# EAGLE schematic Resistor_Resistor (EAGLE 8.3.0), part 3 of 43 (continued)
## Parts (continued)
R3670  10K  RESISTOR_0201  [0201]
R3671  10K  RESISTOR_0201  [0201]
R3672  10K  RESISTOR_0201  [0201]
R3673  10K  RESISTOR_0201  [0201]
R3674  10K  RESISTOR_0201  [0201]
R3675  10K  RESISTOR_0201  [0201]
R3676  10K  RESISTOR_0201  [0201]
R3677  10K  RESISTOR_0201  [0201]
R3678  10K  RESISTOR_0201  [0201]
R3679  10K  RESISTOR_0201  [0201]
R3680  10K  RESISTOR_0201  [0201]
R3681  10K  RESISTOR_0201  [0201]
R3682  10K  RESISTOR_0201  [0201]
R3683  10K  RESISTOR_0201  [0201]
R3684  10K  RESISTOR_0201  [0201]
R3685  10K  RESISTOR_0201  [0201]
R3686  10K  RESISTOR_0201  [0201]
R3687  10K  RESISTOR_0201  [0201]
R3688  10K  RESISTOR_0201  [0201]
R3689  10K  RESISTOR_0201  [0201]
R3690  10K  RESISTOR_0201  [0201]
R3691  10K  RESISTOR_0201  [0201]
R3692  10K  RESISTOR_0201  [0201]
R3693  10K  RESISTOR_0201  [0201]
R3694  10K  RESISTOR_0201  [0201]
R3695  10K  RESISTOR_0201  [0201]
R3696  10K  RESISTOR_0201  [0201]
R3697  10K  RESISTOR_0201  [0201]
R3698  10K  RESISTOR_0201  [0201]
R3699  10K  RESISTOR_0201  [0201]
R3700  10K  RESISTOR_0201  [0201]
R3701  10K  RESISTOR_0201  [0201]
R3702  10K  RESISTOR_0201  [0201]
R3703  10K  RESISTOR_0201  [0201]
R3704  10K  RESISTOR_0201  [0201]
R3705  10K  RESISTOR_0201  [0201]
R3706  10K  RESISTOR_0201  [0201]
R3707  10K  RESISTOR_0201  [0201]
R3708  10K  RESISTOR_0201  [0201]
R3709  10K  RESISTOR_0201  [0201]
R3710  10K  RESISTOR_0201  [0201]
R3711  10K  RESISTOR_0201  [0201]
R3712  10K  RESISTOR_0201  [0201]
R3713  10K  RESISTOR_0201  [0201]
R3714  10K  RESISTOR_0201  [0201]
R3715  10K  RESISTOR_0201  [0201]
R3716  10K  RESISTOR_0201  [0201]
R3717  10K  RESISTOR_0201  [0201]
R3718  10K  RESISTOR_0201  [0201]
R3719  10K  RESISTOR_0201  [0201]
R3720  10K  RESISTOR_0201  [0201]
R3721  10K  RESISTOR_0201  [0201]
R3722  10K  RESISTOR_0201  [0201]
R3723  10K  RESISTOR_0201  [0201]
R3724  10K  RESISTOR_0201  [0201]
R3725  10K  RESISTOR_0201  [0201]
R3726  10K  RESISTOR_0201  [0201]
R3727  10K  RESISTOR_0201  [0201]
R3728  10K  RESISTOR_0201  [0201]
R3729  10K  RESISTOR_0201  [0201]
R3730  10K  RESISTOR_0201  [0201]
R3731  10K  RESISTOR_0201  [0201]
R3732  10K  RESISTOR_0201  [0201]
R3733  10K  RESISTOR_0201  [0201]
R3734  10K  RESISTOR_0201  [0201]
R3735  10K  RESISTOR_0201  [0201]
R3736  10K  RESISTOR_0201  [0201]
R3737  10K  RESISTOR_0201  [0201]
R3738  10K  RESISTOR_0201  [0201]
R3739  10K  RESISTOR_0201  [0201]
R3740  10K  RESISTOR_0201  [0201]
R3741  10K  RESISTOR_0201  [0201]
R3742  10K  RESISTOR_0201  [0201]
R3743  10K  RESISTOR_0201  [0201]
R3744  10K  RESISTOR_0201  [0201]
R3745  10K  RESISTOR_0201  [0201]
R3746  10K  RESISTOR_0201  [0201]
R3747  10K  RESISTOR_0201  [0201]
R3748  10K  RESISTOR_0201  [0201]
R3749  10K  RESISTOR_0201  [0201]
R3750  10K  RESISTOR_0201  [0201]
R3751  10K  RESISTOR_0201  [0201]
R3752  10K  RESISTOR_0201  [0201]
R3753  10K  RESISTOR_0201  [0201]
R3754  10K  RESISTOR_0201  [0201]
R3755  10K  RESISTOR_0201  [0201]
R3756  10K  RESISTOR_0201  [0201]
R3757  10K  RESISTOR_0201  [0201]
R3758  10K  RESISTOR_0201  [0201]
R3759  10K  RESISTOR_0201  [0201]
R3760  10K  RESISTOR_0201  [0201]
R3761  10K  RESISTOR_0201  [0201]
R3762  10K  RESISTOR_0201  [0201]
R3763  10K  RESISTOR_0201  [0201]
R3764  10K  RESISTOR_0201  [0201]
R3765  10K  RESISTOR_0201  [0201]
R3766  10K  RESISTOR_0201  [0201]
R3767  10K  RESISTOR_0201  [0201]
R3768  10K  RESISTOR_0201  [0201]
R3769  10K  RESISTOR_0201  [0201]
R3770  10K  RESISTOR_0201  [0201]
R3771  10K  RESISTOR_0201  [0201]
R3772  10K  RESISTOR_0201  [0201]
R3773  10K  RESISTOR_0201  [0201]
R3774  10K  RESISTOR_0201  [0201]
R3775  10K  RESISTOR_0201  [0201]
R3776  10K  RESISTOR_0201  [0201]
R3777  10K  RESISTOR_0201  [0201]
R3778  10K  RESISTOR_0201  [0201]
R3779  10K  RESISTOR_0201  [0201]
R3780  10K  RESISTOR_0201  [0201]
R3781  10K  RESISTOR_0201  [0201]
R3782  10K  RESISTOR_0201  [0201]
R3783  10K  RESISTOR_0201  [0201]
R3784  10K  RESISTOR_0201  [0201]
R3785  10K  RESISTOR_0201  [0201]
R3786  10K  RESISTOR_0201  [0201]
R3787  10K  RESISTOR_0201  [0201]
R3788  10K  RESISTOR_0201  [0201]
R3789  10K  RESISTOR_0201  [0201]
R3790  10K  RESISTOR_0201  [0201]
R3791  10K  RESISTOR_0201  [0201]
R3792  10K  RESISTOR_0201  [0201]
R3793  10K  RESISTOR_0201  [0201]
R3794  10K  RESISTOR_0201  [0201]
R3795  10K  RESISTOR_0201  [0201]
R3796  10K  RESISTOR_0201  [0201]
R3797  10K  RESISTOR_0201  [0201]
R3798  10K  RESISTOR_0201  [0201]
R3799  10K  RESISTOR_0201  [0201]
R3800  10K  RESISTOR_0201  [0201]
R3801  10K  RESISTOR_0201  [0201]
R3802  10K  RESISTOR_0201  [0201]
R3803  10K  RESISTOR_0201  [0201]
R3804  10K  RESISTOR_0201  [0201]
R3805  10K  RESISTOR_0201  [0201]
R3806  10K  RESISTOR_0201  [0201]
R3807  10K  RESISTOR_0201  [0201]
R3808  10K  RESISTOR_0201  [0201]
R3809  10K  RESISTOR_0201  [0201]
R3810  10K  RESISTOR_0201  [0201]
R3811  10K  RESISTOR_0201  [0201]
R3812  10K  RESISTOR_0201  [0201]
R3813  10K  RESISTOR_0201  [0201]
R3814  10K  RESISTOR_0201  [0201]
R3815  10K  RESISTOR_0201  [0201]
R3816  10K  RESISTOR_0201  [0201]
R3817  10K  RESISTOR_0201  [0201]
R3818  10K  RESISTOR_0201  [0201]
R3819  10K  RESISTOR_0201  [0201]
R3820  10K  RESISTOR_0201  [0201]
R3821  10K  RESISTOR_0201  [0201]
R3822  10K  RESISTOR_0201  [0201]
R3823  10K  RESISTOR_0201  [0201]
R3824  10K  RESISTOR_0201  [0201]
R3825  10K  RESISTOR_0201  [0201]
R3826  10K  RESISTOR_0201  [0201]
R3827  10K  RESISTOR_0201  [0201]
R3828  10K  RESISTOR_0201  [0201]
R3829  10K  RESISTOR_0201  [0201]
R3830  10K  RESISTOR_0201  [0201]
R3831  10K  RESISTOR_0201  [0201]
R3832  10K  RESISTOR_0201  [0201]
R3833  10K  RESISTOR_0201  [0201]
R3834  10K  RESISTOR_0201  [0201]
R3835  10K  RESISTOR_0201  [0201]
R3836  10K  RESISTOR_0201  [0201]
R3837  10K  RESISTOR_0201  [0201]
R3838  10K  RESISTOR_0201  [0201]
R3839  10K  RESISTOR_0201  [0201]
R3840  10K  RESISTOR_0201  [0201]
R3841  10K  RESISTOR_0201  [0201]
R3842  10K  RESISTOR_0201  [0201]
R3843  10K  RESISTOR_0201  [0201]
R3844  10K  RESISTOR_0201  [0201]
R3845  10K  RESISTOR_0201  [0201]
R3846  10K  RESISTOR_0201  [0201]
R3847  10K  RESISTOR_0201  [0201]
R3848  10K  RESISTOR_0201  [0201]
R3849  10K  RESISTOR_0201  [0201]
R3850  10K  RESISTOR_0201  [0201]
R3851  10K  RESISTOR_0201  [0201]
R3852  10K  RESISTOR_0201  [0201]
R3853  10K  RESISTOR_0201  [0201]
R3854  10K  RESISTOR_0201  [0201]
R3855  10K  RESISTOR_0201  [0201]
R3856  10K  RESISTOR_0201  [0201]
R3857  10K  RESISTOR_0201  [0201]
R3858  10K  RESISTOR_0201  [0201]
R3859  10K  RESISTOR_0201  [0201]
R3860  10K  RESISTOR_0201  [0201]
R3861  10K  RESISTOR_0201  [0201]
R3862  10K  RESISTOR_0201  [0201]
R3863  10K  RESISTOR_0201  [0201]
R3864  10K  RESISTOR_0201  [0201]
R3865  10K  RESISTOR_0201  [0201]
R3866  10K  RESISTOR_0201  [0201]
R3867  10K  RESISTOR_0201  [0201]
R3868  10K  RESISTOR_0201  [0201]
R3869  10K  RESISTOR_0201  [0201]
R3870  10K  RESISTOR_0201  [0201]
R3871  10K  RESISTOR_0201  [0201]
R3872  10K  RESISTOR_0201  [0201]
R3873  10K  RESISTOR_0201  [0201]
R3874  10K  RESISTOR_0201  [0201]
R3875  10K  RESISTOR_0201  [0201]
R3876  10K  RESISTOR_0201  [0201]
R3877  10K  RESISTOR_0201  [0201]
R3878  10K  RESISTOR_0201  [0201]
R3879  10K  RESISTOR_0201  [0201]
R3880  10K  RESISTOR_0201  [0201]
R3881  10K  RESISTOR_0201  [0201]
R3882  10K  RESISTOR_0201  [0201]
R3883  10K  RESISTOR_0201  [0201]
R3884  10K  RESISTOR_0201  [0201]
R3885  10K  RESISTOR_0201  [0201]
R3886  10K  RESISTOR_0201  [0201]
R3887  10K  RESISTOR_0201  [0201]
R3888  10K  RESISTOR_0201  [0201]
R3889  10K  RESISTOR_0201  [0201]
R3890  10K  RESISTOR_0201  [0201]
R3891  10K  RESISTOR_0201  [0201]
R3892  10K  RESISTOR_0201  [0201]
R3893  10K  RESISTOR_0201  [0201]
R3894  10K  RESISTOR_0201  [0201]
R3895  10K  RESISTOR_0201  [0201]
R3896  10K  RESISTOR_0201  [0201]
R3897  10K  RESISTOR_0201  [0201]
R3898  10K  RESISTOR_0201  [0201]
R3899  10K  RESISTOR_0201  [0201]
R3900  10K  RESISTOR_0201  [0201]
R3901  10K  RESISTOR_0201  [0201]
R3902  10K  RESISTOR_0201  [0201]
R3903  10K  RESISTOR_0201  [0201]
R3904  10K  RESISTOR_0201  [0201]
R3905  10K  RESISTOR_0201  [0201]
R3906  10K  RESISTOR_0201  [0201]
R3907  10K  RESISTOR_0201  [0201]
R3908  10K  RESISTOR_0201  [0201]
R3909  10K  RESISTOR_0201  [0201]
R3910  10K  RESISTOR_0201  [0201]
R3911  10K  RESISTOR_0201  [0201]
R3912  10K  RESISTOR_0201  [0201]
R3913  10K  RESISTOR_0201  [0201]
R3914  10K  RESISTOR_0201  [0201]
R3915  10K  RESISTOR_0201  [0201]
R3916  10K  RESISTOR_0201  [0201]
R3917  10K  RESISTOR_0201  [0201]
R3918  10K  RESISTOR_0201  [0201]
R3919  10K  RESISTOR_0201  [0201]
R3920  10K  RESISTOR_0201  [0201]
R3921  10K  RESISTOR_0201  [0201]
R3922  10K  RESISTOR_0201  [0201]
R3923  10K  RESISTOR_0201  [0201]
R3924  10K  RESISTOR_0201  [0201]
R3925  10K  RESISTOR_0201  [0201]
R3926  10K  RESISTOR_0201  [0201]
R3927  10K  RESISTOR_0201  [0201]
R3928  10K  RESISTOR_0201  [0201]
R3929  10K  RESISTOR_0201  [0201]
R3930  10K  RESISTOR_0201  [0201]
R3931  10K  RESISTOR_0201  [0201]
R3932  10K  RESISTOR_0201  [0201]
R3933  10K  RESISTOR_0201  [0201]
R3934  10K  RESISTOR_0201  [0201]
R3935  10K  RESISTOR_0201  [0201]
R3936  10K  RESISTOR_0201  [0201]
R3937  10K  RESISTOR_0201  [0201]
R3938  10K  RESISTOR_0201  [0201]
R3939  10K  RESISTOR_0201  [0201]
R3940  10K  RESISTOR_0201  [0201]
R3941  10K  RESISTOR_0201  [0201]
R3942  10K  RESISTOR_0201  [0201]
R3943  10K  RESISTOR_0201  [0201]
R3944  10K  RESISTOR_0201  [0201]
R3945  10K  RESISTOR_0201  [0201]
R3946  10K  RESISTOR_0201  [0201]
R3947  10K  RESISTOR_0201  [0201]
R3948  10K  RESISTOR_0201  [0201]
R3949  10K  RESISTOR_0201  [0201]
R3950  10K  RESISTOR_0201  [0201]
R3951  10K  RESISTOR_0201  [0201]
R3952  10K  RESISTOR_0201  [0201]
R3953  10K  RESISTOR_0201  [0201]
R3954  10K  RESISTOR_0201  [0201]
R3955  10K  RESISTOR_0201  [0201]
R3956  10K  RESISTOR_0201  [0201]
R3957  10K  RESISTOR_0201  [0201]
R3958  10K  RESISTOR_0201  [0201]
R3959  10K  RESISTOR_0201  [0201]
R3960  10K  RESISTOR_0201  [0201]
R3961  10K  RESISTOR_0201  [0201]
R3962  10K  RESISTOR_0201  [0201]
R3963  10K  RESISTOR_0201  [0201]
R3964  10K  RESISTOR_0201  [0201]
R3965  10K  RESISTOR_0201  [0201]
R3966  10K  RESISTOR_0201  [0201]
R3967  10K  RESISTOR_0201  [0201]
R3968  10K  RESISTOR_0201  [0201]
R3969  10K  RESISTOR_0201  [0201]
R3970  10K  RESISTOR_0201  [0201]
R3971  10K  RESISTOR_0201  [0201]
R3972  10K  RESISTOR_0201  [0201]
R3973  10K  RESISTOR_0201  [0201]
R3974  10K  RESISTOR_0201  [0201]
R3975  10K  RESISTOR_0201  [0201]
R3976  10K  RESISTOR_0201  [0201]
R3977  10K  RESISTOR_0201  [0201]
R3978  10K  RESISTOR_0201  [0201]
R3979  10K  RESISTOR_0201  [0201]
R3980  10K  RESISTOR_0201  [0201]
R3981  10K  RESISTOR_0201  [0201]
R3982  10K  RESISTOR_0201  [0201]
R3983  10K  RESISTOR_0201  [0201]
R3984  10K  RESISTOR_0201  [0201]
R3985  10K  RESISTOR_0201  [0201]
R3986  10K  RESISTOR_0201  [0201]
R3987  10K  RESISTOR_0201  [0201]
R3988  10K  RESISTOR_0201  [0201]
R3989  10K  RESISTOR_0201  [0201]
R3990  10K  RESISTOR_0201  [0201]
R3991  10K  RESISTOR_0201  [0201]
R3992  10K  RESISTOR_0201  [0201]
R3993  10K  RESISTOR_0201  [0201]
R3994  10K  RESISTOR_0201  [0201]
R3995  10K  RESISTOR_0201  [0201]
R3996  10K  RESISTOR_0201  [0201]
R3997  10K  RESISTOR_0201  [0201]
R3998  10K  RESISTOR_0201  [0201]
R3999  10K  RESISTOR_0201  [0201]
R4000  10K  RESISTOR_0201  [0201]
R4001  10K  RESISTOR_0201  [0201]
R4002  10K  RESISTOR_0201  [0201]
R4003  10K  RESISTOR_0201  [0201]
R4004  10K  RESISTOR_0201  [0201]
R4005  10K  RESISTOR_0201  [0201]
R4006  10K  RESISTOR_0201  [0201]
R4007  10K  RESISTOR_0201  [0201]
R4008  10K  RESISTOR_0201  [0201]
R4009  10K  RESISTOR_0201  [0201]
R4010  10K  RESISTOR_0201  [0201]
R4011  10K  RESISTOR_0201  [0201]
R4012  10K  RESISTOR_0201  [0201]
R4013  10K  RESISTOR_0201  [0201]
R4014  10K  RESISTOR_0201  [0201]
R4015  10K  RESISTOR_0201  [0201]
R4016  10K  RESISTOR_0201  [0201]
R4017  10K  RESISTOR_0201  [0201]
R4018  10K  RESISTOR_0201  [0201]
R4019  10K  RESISTOR_0201  [0201]
R4020  10K  RESISTOR_0201  [0201]
R4021  10K  RESISTOR_0201  [0201]
R4022  10K  RESISTOR_0201  [0201]
R4023  10K  RESISTOR_0201  [0201]
R4024  10K  RESISTOR_0201  [0201]
R4025  10K  RESISTOR_0201  [0201]
R4026  10K  RESISTOR_0201  [0201]
R4027  10K  RESISTOR_0201  [0201]
R4028  10K  RESISTOR_0201  [0201]
R4029  10K  RESISTOR_0201  [0201]
R4030  10K  RESISTOR_0201  [0201]
R4031  10K  RESISTOR_0201  [0201]
R4032  10K  RESISTOR_0201  [0201]
R4033  10K  RESISTOR_0201  [0201]
R4034  10K  RESISTOR_0201  [0201]
R4035  10K  RESISTOR_0201  [0201]
R4036  10K  RESISTOR_0201  [0201]
R4037  10K  RESISTOR_0201  [0201]
R4038  10K  RESISTOR_0201  [0201]
R4039  10K  RESISTOR_0201  [0201]
R4040  10K  RESISTOR_0201  [0201]
R4041  10K  RESISTOR_0201  [0201]
R4042  10K  RESISTOR_0201  [0201]
R4043  10K  RESISTOR_0201  [0201]
R4044  10K  RESISTOR_0201  [0201]
R4045  10K  RESISTOR_0201  [0201]
R4046  10K  RESISTOR_0201  [0201]
R4047  10K  RESISTOR_0201  [0201]
R4048  10K  RESISTOR_0201  [0201]
R4049  10K  RESISTOR_0201  [0201]
R4050  10K  RESISTOR_0201  [0201]
R4051  10K  RESISTOR_0201  [0201]
R4052  10K  RESISTOR_0201  [0201]
R4053  10K  RESISTOR_0201  [0201]
R4054  10K  RESISTOR_0201  [0201]
R4055  10K  RESISTOR_0201  [0201]
R4056  10K  RESISTOR_0201  [0201]
R4057  10K  RESISTOR_0201  [0201]
R4058  10K  RESISTOR_0201  [0201]
R4059  10K  RESISTOR_0201  [0201]
R4060  10K  RESISTOR_0201  [0201]
R4061  10K  RESISTOR_0201  [0201]
R4062  10K  RESISTOR_0201  [0201]
R4063  10K  RESISTOR_0201  [0201]
R4064  10K  RESISTOR_0201  [0201]
R4065  10K  RESISTOR_0201  [0201]
R4066  10K  RESISTOR_0201  [0201]
R4067  10K  RESISTOR_0201  [0201]
R4068  10K  RESISTOR_0201  [0201]
R4069  10K  RESISTOR_0201  [0201]
R4070  10K  RESISTOR_0201  [0201]
R4071  10K  RESISTOR_0201  [0201]
R4072  10K  RESISTOR_0201  [0201]
R4073  10K  RESISTOR_0201  [0201]
R4074  10K  RESISTOR_0201  [0201]
R4075  10K  RESISTOR_0201  [0201]
R4076  10K  RESISTOR_0201  [0201]
R4077  10K  RESISTOR_0201  [0201]
R4078  10K  RESISTOR_0201  [0201]
R4079  10K  RESISTOR_0201  [0201]
R4080  10K  RESISTOR_0201  [0201]
R4081  10K  RESISTOR_0201  [0201]
R4082  10K  RESISTOR_0201  [0201]
R4083  10K  RESISTOR_0201  [0201]
R4084  10K  RESISTOR_0201  [0201]
R4085  10K  RESISTOR_0201  [0201]
R4086  10K  RESISTOR_0201  [0201]
R4087  10K  RESISTOR_0201  [0201]
R4088  10K  RESISTOR_0201  [0201]
R4089  10K  RESISTOR_0201  [0201]
R4090  10K  RESISTOR_0201  [0201]
R4091  10K  RESISTOR_0201  [0201]
R4092  10K  RESISTOR_0201  [0201]
R4093  10K  RESISTOR_0201  [0201]
R4094  10K  RESISTOR_0201  [0201]
R4095  10K  RESISTOR_0201  [0201]
R4096  10K  RESISTOR_0201  [0201]
R4097  10K  RESISTOR_0201  [0201]
R4098  10K  RESISTOR_0201  [0201]
R4099  10K  RESISTOR_0201  [0201]
R4100  10K  RESISTOR_0201  [0201]
R4101  10K  RESISTOR_0201  [0201]
R4102  10K  RESISTOR_0201  [0201]
R4103  10K  RESISTOR_0201  [0201]
R4104  10K  RESISTOR_0201  [0201]
R4105  10K  RESISTOR_0201  [0201]
R4106  10K  RESISTOR_0201  [0201]
R4107  10K  RESISTOR_0201  [0201]
R4108  10K  RESISTOR_0201  [0201]
R4109  10K  RESISTOR_0201  [0201]
R4110  10K  RESISTOR_0201  [0201]
R4111  10K  RESISTOR_0201  [0201]
R4112  10K  RESISTOR_0201  [0201]
R4113  10K  RESISTOR_0201  [0201]
R4114  10K  RESISTOR_0201  [0201]
R4115  10K  RESISTOR_0201  [0201]
R4116  10K  RESISTOR_0201  [0201]
R4117  10K  RESISTOR_0201  [0201]
R4118  10K  RESISTOR_0201  [0201]
R4119  10K  RESISTOR_0201  [0201]
R4120  10K  RESISTOR_0201  [0201]
R4121  10K  RESISTOR_0201  [0201]
R4122  10K  RESISTOR_0201  [0201]
R4123  10K  RESISTOR_0201  [0201]
R4124  10K  RESISTOR_0201  [0201]
R4125  10K  RESISTOR_0201  [0201]
R4126  10K  RESISTOR_0201  [0201]
R4127  10K  RESISTOR_0201  [0201]
R4128  10K  RESISTOR_0201  [0201]
R4129  10K  RESISTOR_0201  [0201]
R4130  10K  RESISTOR_0201  [0201]
R4131  10K  RESISTOR_0201  [0201]
R4132  10K  RESISTOR_0201  [0201]
R4133  10K  RESISTOR_0201  [0201]
R4134  10K  RESISTOR_0201  [0201]
R4135  10K  RESISTOR_0201  [0201]
R4136  10K  RESISTOR_0201  [0201]
R4137  10K  RESISTOR_0201  [0201]
R4138  10K  RESISTOR_0201  [0201]
R4139  10K  RESISTOR_0201  [0201]
R4140  10K  RESISTOR_0201  [0201]
R4141  10K  RESISTOR_0201  [0201]
R4142  10K  RESISTOR_0201  [0201]
R4143  10K  RESISTOR_0201  [0201]
R4144  10K  RESISTOR_0201  [0201]
R4145  10K  RESISTOR_0201  [0201]
R4146  10K  RESISTOR_0201  [0201]
R4147  10K  RESISTOR_0201  [0201]
R4148  10K  RESISTOR_0201  [0201]
R4149  10K  RESISTOR_0201  [0201]
R4150  10K  RESISTOR_0201  [0201]
R4151  10K  RESISTOR_0201  [0201]
R4152  10K  RESISTOR_0201  [0201]
R4153  10K  RESISTOR_0201  [0201]
R4154  10K  RESISTOR_0201  [0201]
R4155  10K  RESISTOR_0201  [0201]
R4156  10K  RESISTOR_0201  [0201]
R4157  10K  RESISTOR_0201  [0201]
R4158  10K  RESISTOR_0201  [0201]
R4159  10K  RESISTOR_0201  [0201]
R4160  10K  RESISTOR_0201  [0201]
R4161  10K  RESISTOR_0201  [0201]
R4162  10K  RESISTOR_0201  [0201]
R4163  10K  RESISTOR_0201  [0201]
R4164  10K  RESISTOR_0201  [0201]
R4165  10K  RESISTOR_0201  [0201]
R4166  10K  RESISTOR_0201  [0201]
R4167  10K  RESISTOR_0201  [0201]
R4168  10K  RESISTOR_0201  [0201]
R4169  10K  RESISTOR_0201  [0201]
R4170  10K  RESISTOR_0201  [0201]
R4171  10K  RESISTOR_0201  [0201]
R4172  10K  RESISTOR_0201  [0201]
R4173  10K  RESISTOR_0201  [0201]
R4174  10K  RESISTOR_0201  [0201]
R4175  10K  RESISTOR_0201  [0201]
R4176  10K  RESISTOR_0201  [0201]
R4177  10K  RESISTOR_0201  [0201]
R4178  10K  RESISTOR_0201  [0201]
R4179  10K  RESISTOR_0201  [0201]
R4180  10K  RESISTOR_0201  [0201]
R4181  10K  RESISTOR_0201  [0201]
R4182  10K  RESISTOR_0201  [0201]
R4183  10K  RESISTOR_0201  [0201]
R4184  10K  RESISTOR_0201  [0201]
R4185  10K  RESISTOR_0201  [0201]
R4186  10K  RESISTOR_0201  [0201]
R4187  10K  RESISTOR_0201  [0201]
R4188  10K  RESISTOR_0201  [0201]
R4189  10K  RESISTOR_0201  [0201]
R4190  10K  RESISTOR_0201  [0201]
R4191  10K  RESISTOR_0201  [0201]
R4192  10K  RESISTOR_0201  [0201]
R4193  10K  RESISTOR_0201  [0201]
R4194  10K  RESISTOR_0201  [0201]
R4195  10K  RESISTOR_0201  [0201]
R4196  10K  RESISTOR_0201  [0201]
R4197  10K  RESISTOR_0201  [0201]
R4198  10K  RESISTOR_0201  [0201]
R4199  10K  RESISTOR_0201  [0201]
R4200  10K  RESISTOR_0201  [0201]
R4201  10K  RESISTOR_0201  [0201]
R4202  10K  RESISTOR_0201  [0201]
R4203  10K  RESISTOR_0201  [0201]
R4204  10K  RESISTOR_0201  [0201]
R4205  10K  RESISTOR_0201  [0201]
R4206  10K  RESISTOR_0201  [0201]
R4207  10K  RESISTOR_0201  [0201]
R4208  10K  RESISTOR_0201  [0201]
R4209  10K  RESISTOR_0201  [0201]
R4210  10K  RESISTOR_0201  [0201]
R4211  10K  RESISTOR_0201  [0201]
R4212  10K  RESISTOR_0201  [0201]
R4213  10K  RESISTOR_0201  [0201]
R4214  10K  RESISTOR_0201  [0201]
R4215  10K  RESISTOR_0201  [0201]
R4216  10K  RESISTOR_0201  [0201]
R4217  10K  RESISTOR_0201  [0201]
R4218  10K  RESISTOR_0201  [0201]
R4219  10K  RESISTOR_0201  [0201]
R4220  10K  RESISTOR_0201  [0201]
R4221  10K  RESISTOR_0201  [0201]
R4222  10K  RESISTOR_0201  [0201]
R4223  10K  RESISTOR_0201  [0201]
R4224  10K  RESISTOR_0201  [0201]
R4225  10K  RESISTOR_0201  [0201]
R4226  10K  RESISTOR_0201  [0201]
R4227  10K  RESISTOR_0201  [0201]
R4228  10K  RESISTOR_0201  [0201]
R4229  10K  RESISTOR_0201  [0201]
R4230  10K  RESISTOR_0201  [0201]
R4231  10K  RESISTOR_0201  [0201]
R4232  10K  RESISTOR_0201  [0201]
R4233  10K  RESISTOR_0201  [0201]
R4234  10K  RESISTOR_0201  [0201]
R4235  10K  RESISTOR_0201  [0201]
R4236  10K  RESISTOR_0201  [0201]
R4237  10K  RESISTOR_0201  [0201]
R4238  10K  RESISTOR_0201  [0201]
R4239  10K  RESISTOR_0201  [0201]
R4240  10K  RESISTOR_0201  [0201]
R4241  10K  RESISTOR_0201  [0201]
R4242  10K  RESISTOR_0201  [0201]
R4243  10K  RESISTOR_0201  [0201]
R4244  10K  RESISTOR_0201  [0201]
R4245  10K  RESISTOR_0201  [0201]
R4246  10K  RESISTOR_0201  [0201]
R4247  10K  RESISTOR_0201  [0201]
R4248  10K  RESISTOR_0201  [0201]
R4249  10K  RESISTOR_0201  [0201]
R4250  10K  RESISTOR_0201  [0201]
R4251  10K  RESISTOR_0201  [0201]
R4252  10K  RESISTOR_0201  [0201]
R4253  10K  RESISTOR_0201  [0201]
R4254  10K  RESISTOR_0201  [0201]
R4255  10K  RESISTOR_0201  [0201]
R4256  10K  RESISTOR_0201  [0201]
R4257  10K  RESISTOR_0201  [0201]
R4258  10K  RESISTOR_0201  [0201]
R4259  10K  RESISTOR_0201  [0201]
R4260  10K  RESISTOR_0201  [0201]
R4261  10K  RESISTOR_0201  [0201]
R4262  10K  RESISTOR_0201  [0201]
R4263  10K  RESISTOR_0201  [0201]
R4264  10K  RESISTOR_0201  [0201]
R4265  10K  RESISTOR_0201  [0201]
R4266  10K  RESISTOR_0201  [0201]
R4267  10K  RESISTOR_0201  [0201]
R4268  10K  RESISTOR_0201  [0201]
R4269  10K  RESISTOR_0201  [0201]
R4270  10K  RESISTOR_0201  [0201]
R4271  10K  RESISTOR_0201  [0201]
R4272  10K  RESISTOR_0201  [0201]
R4273  10K  RESISTOR_0201  [0201]
R4274  10K  RESISTOR_0201  [0201]
R4275  10K  RESISTOR_0201  [0201]
R4276  10K  RESISTOR_0201  [0201]
R4277  10K  RESISTOR_0201  [0201]
R4278  10K  RESISTOR_0201  [0201]
R4279  10K  RESISTOR_0201  [0201]
R4280  10K  RESISTOR_0201  [0201]
R4281  10K  RESISTOR_0201  [0201]
R4282  10K  RESISTOR_0201  [0201]
R4283  10K  RESISTOR_0201  [0201]
R4284  10K  RESISTOR_0201  [0201]
R4285  10K  RESISTOR_0201  [0201]
R4286  10K  RESISTOR_0201  [0201]
R4287  10K  RESISTOR_0201  [0201]
R4288  10K  RESISTOR_0201  [0201]
R4289  10K  RESISTOR_0201  [0201]
R4290  10K  RESISTOR_0201  [0201]
R4291  10K  RESISTOR_0201  [0201]
R4292  10K  RESISTOR_0201  [0201]
R4293  10K  RESISTOR_0201  [0201]
R4294  10K  RESISTOR_0201  [0201]
R4295  10K  RESISTOR_0201  [0201]
R4296  10K  RESISTOR_0201  [0201]
R4297  10K  RESISTOR_0201  [0201]
R4298  10K  RESISTOR_0201  [0201]
R4299  10K  RESISTOR_0201  [0201]
R4300  10K  RESISTOR_0201  [0201]
R4301  10K  RESISTOR_0201  [0201]
R4302  10K  RESISTOR_0201  [0201]
R4303  10K  RESISTOR_0201  [0201]
R4304  10K  RESISTOR_0201  [0201]
R4305  10K  RESISTOR_0201  [0201]
R4306  10K  RESISTOR_0201  [0201]
R4307  10K  RESISTOR_0201  [0201]
R4308  10K  RESISTOR_0201  [0201]
R4309  10K  RESISTOR_0201  [0201]
R4310  10K  RESISTOR_0201  [0201]
R4311  10K  RESISTOR_0201  [0201]
R4312  10K  RESISTOR_0201  [0201]
R4313  10K  RESISTOR_0201  [0201]
R4314  10K  RESISTOR_0201  [0201]
R4315  10K  RESISTOR_0201  [0201]
R4316  10K  RESISTOR_0201  [0201]
R4317  10K  RESISTOR_0201  [0201]
R4318  10K  RESISTOR_0201  [0201]
R4319  10K  RESISTOR_0201  [0201]
R4320  10K  RESISTOR_0201  [0201]
R4321  10K  RESISTOR_0201  [0201]
R4322  10K  RESISTOR_0201  [0201]
R4323  10K  RESISTOR_0201  [0201]
R4324  10K  RESISTOR_0201  [0201]
R4325  10K  RESISTOR_0201  [0201]
R4326  10K  RESISTOR_0201  [0201]
R4327  10K  RESISTOR_0201  [0201]
R4328  10K  RESISTOR_0201  [0201]
R4329  10K  RESISTOR_0201  [0201]
R4330  10K  RESISTOR_0201  [0201]
R4331  10K  RESISTOR_0201  [0201]
R4332  10K  RESISTOR_0201  [0201]
R4333  10K  RESISTOR_0201  [0201]
R4334  10K  RESISTOR_0201  [0201]
R4335  10K  RESISTOR_0201  [0201]
R4336  10K  RESISTOR_0201  [0201]
R4337  10K  RESISTOR_0201  [0201]
R4338  10K  RESISTOR_0201  [0201]
R4339  10K  RESISTOR_0201  [0201]
R4340  10K  RESISTOR_0201  [0201]
R4341  10K  RESISTOR_0201  [0201]
R4342  10K  RESISTOR_0201  [0201]
R4343  10K  RESISTOR_0201  [0201]
R4344  10K  RESISTOR_0201  [0201]
R4345  10K  RESISTOR_0201  [0201]
R4346  10K  RESISTOR_0201  [0201]
R4347  10K  RESISTOR_0201  [0201]
R4348  10K  RESISTOR_0201  [0201]
R4349  10K  RESISTOR_0201  [0201]
R4350  10K  RESISTOR_0201  [0201]
R4351  10K  RESISTOR_0201  [0201]
R4352  10K  RESISTOR_0201  [0201]
R4353  10K  RESISTOR_0201  [0201]
R4354  10K  RESISTOR_0201  [0201]
R4355  10K  RESISTOR_0201  [0201]
R4356  10K  RESISTOR_0201  [0201]
R4357  10K  RESISTOR_0201  [0201]
R4358  10K  RESISTOR_0201  [0201]
R4359  10K  RESISTOR_0201  [0201]
R4360  10K  RESISTOR_0201  [0201]
R4361  10K  RESISTOR_0201  [0201]
R4362  10K  RESISTOR_0201  [0201]
R4363  10K  RESISTOR_0201  [0201]
R4364  10K  RESISTOR_0201  [0201]
R4365  10K  RESISTOR_0201  [0201]
R4366  10K  RESISTOR_0201  [0201]
R4367  10K  RESISTOR_0201  [0201]
R4368  10K  RESISTOR_0201  [0201]
R4369  10K  RESISTOR_0201  [0201]
R4370  10K  RESISTOR_0201  [0201]
R4371  10K  RESISTOR_0201  [0201]
R4372  10K  RESISTOR_0201  [0201]
R4373  10K  RESISTOR_0201  [0201]
R4374  10K  RESISTOR_0201  [0201]
R4375  10K  RESISTOR_0201  [0201]
R4376  10K  RESISTOR_0201  [0201]
R4377  10K  RESISTOR_0201  [0201]
R4378  10K  RESISTOR_0201  [0201]
R4379  10K  RESISTOR_0201  [0201]
R4380  10K  RESISTOR_0201  [0201]
R4381  10K  RESISTOR_0201  [0201]
R4382  10K  RESISTOR_0201  [0201]
R4383  10K  RESISTOR_0201  [0201]
R4384  10K  RESISTOR_0201  [0201]
R4385  10K  RESISTOR_0201  [0201]
R4386  10K  RESISTOR_0201  [0201]
R4387  10K  RESISTOR_0201  [0201]
R4388  10K  RESISTOR_0201  [0201]
R4389  10K  RESISTOR_0201  [0201]
R4390  10K  RESISTOR_0201  [0201]
R4391  10K  RESISTOR_0201  [0201]
R4392  10K  RESISTOR_0201  [0201]
R4393  10K  RESISTOR_0201  [0201]
R4394  10K  RESISTOR_0201  [0201]
R4395  10K  RESISTOR_0201  [0201]
R4396  10K  RESISTOR_0201  [0201]
R4397  10K  RESISTOR_0201  [0201]
R4398  10K  RESISTOR_0201  [0201]
R4399  10K  RESISTOR_0201  [0201]
R4400  10K  RESISTOR_0201  [0201]